# EasyEDA Pro project ProProject_Avaota Pi A_2024-03-25.epro, board 点位 (continued)
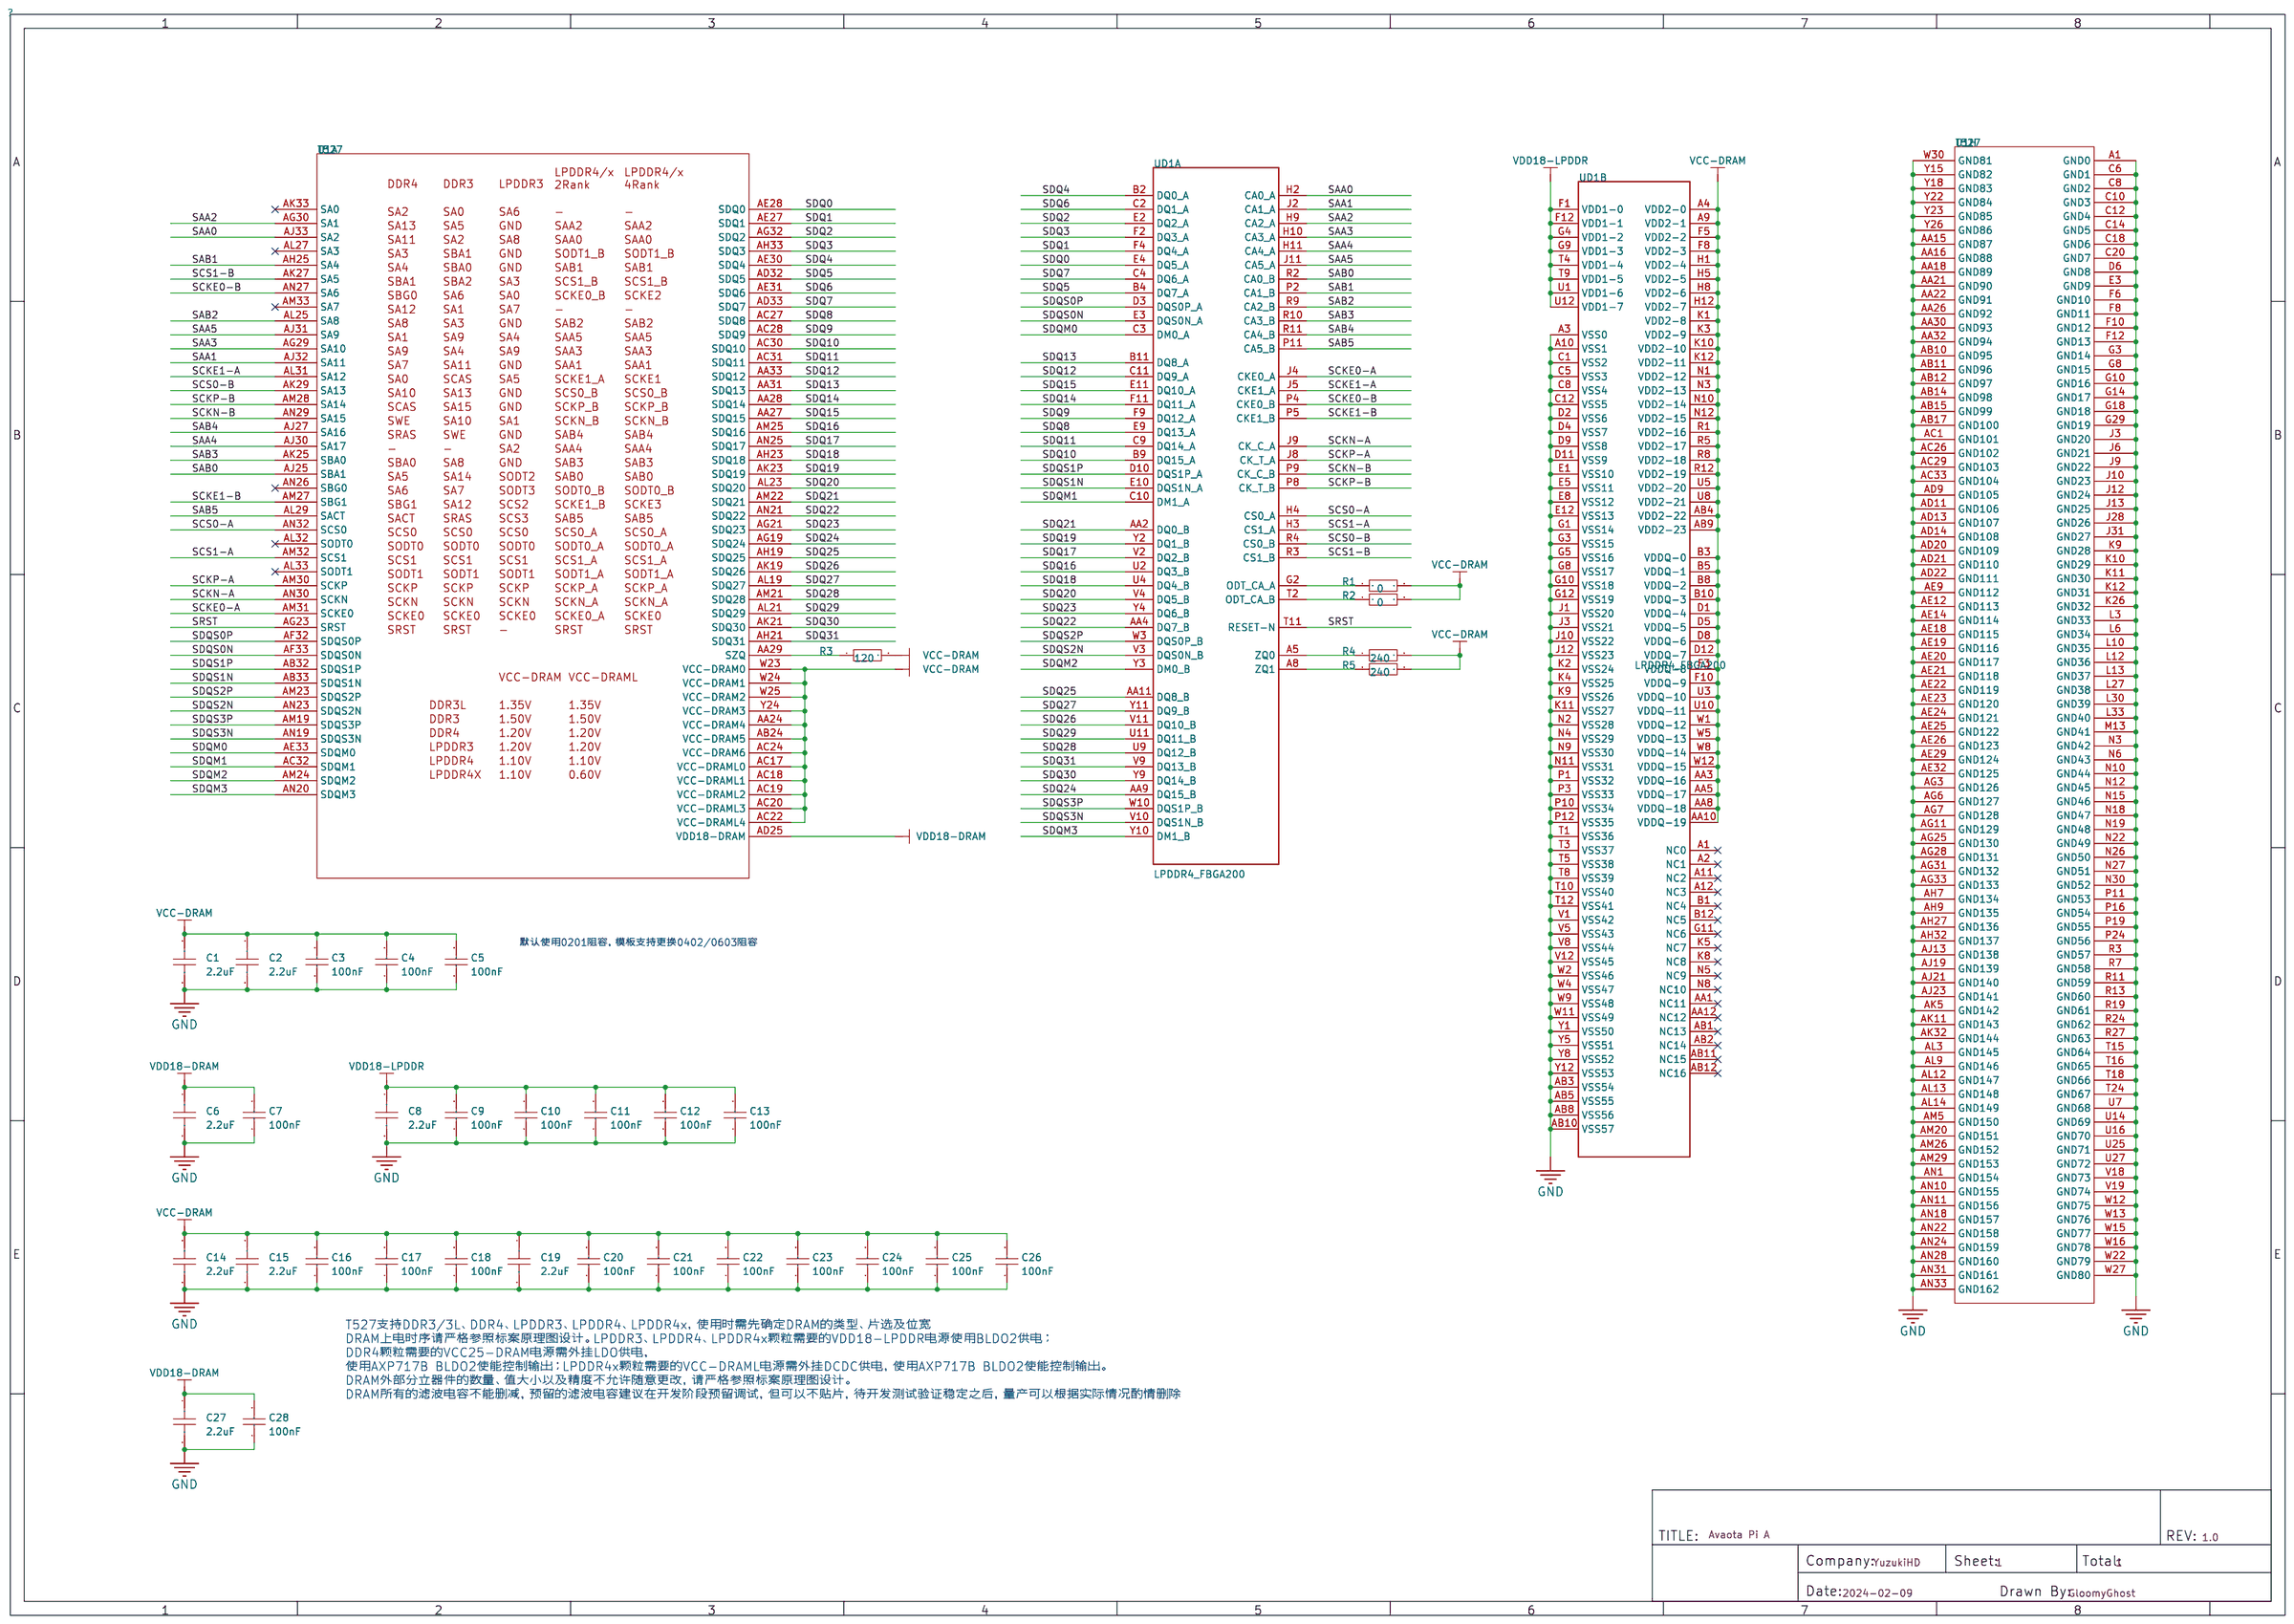
[diagram p0: schematic sheet]
## Routing (per net, layer and track width the routed paths; a pad name or vN(x,y) marks a point on that pad's centre or on a via; arc(x,y) is an arc through that point) (continued)
VCM-ADC: length 0.6
  Bottom Layer w0.203: C112.2 59.72,52.63 59.72,52.45 59.94,52.22 v1(59.94,52.15)
VRA1: length 1
  Top Layer w0.152: v3(56.92,54.15) U14.AG5
  Bottom Layer w0.152: C109.2 57.36,54.15 v3(56.92,54.15)
VRA2: length 1
  Top Layer w0.152: U14.AG4 v3(56.92,54.65)
  Bottom Layer w0.152: v3(56.92,54.65) 57.42,54.65 C110.2
VREFP-ADC: length 1.3
  Bottom Layer w0.102: v3(59.44,52.15) 59.37,52.08 R24.1
  Bottom Layer w0.203: C113.2 59.44,52.19 v3(59.44,52.15)
VRP: length 1
  Bottom Layer w0.178: C111.2 58.52,53.22 v3(58.44,53.15)
WL-REG-ON: length 55.3
  Top Layer w0.076: 61.44,55.64 61.44,55.75 61.68,56 61.68,56.27 61.52,56.44 61.51,56.6 61.43,56.95 61.39,57.32 61.41,57.7 61.5,57.91
  Top Layer w0.102: 17.06,54.76 17.3,54.53 17.3,53.95 v3(17.48,53.77) ; 61.5,57.88 61.75,58.29 62.05,58.6 62.05,60.12 61.39,60.78 56.36,60.78 54.61,59.03 34.75,59.03 27.69,51.97 20.78,51.97 18.97,53.77 v3(18.44,53.77)
  Bottom Layer w0.102: v3(18.44,53.77) v3(17.48,53.77)
WL-WAKE-AP: length 53.7
  Top Layer w0.076: 61.44,56.14 61.44,56.14 61.37,56.22 61.35,56.47 61.18,56.84 61.14,57.35 61.19,57.81 61.46,58.36
  Top Layer w0.102: 61.47,58.34 61.77,58.65 61.77,59.92 61.21,60.48 56.49,60.48 54.74,58.73 34.98,58.73 27.91,51.66 20.55,51.66 18.85,53.37 18.26,53.37 17.96,53.66 17.96,54.76
X32KIN: length 7.9
  Top Layer w0.102: 50.91,52.89 50.66,52.89 50.4,52.63 X2.1 ; 50.91,52.89 R25.1 51.06,53.77 51.36,53.77 51.61,53.51 51.61,51.3 52.27,50.65 U14.AM12 ; 50.91,52.89 50.94,52.87
X32KOUT: length 8
  Top Layer w0.102: X2.2 50.35,55.18 50.62,54.91 C101.2 R25.2 51.02,53.99 51.41,53.99 51.84,53.56 51.84,51.4 52.38,50.87 53.67,50.87 U14.AM11
$1N3725: length 1
  Top Layer w0.254: C43.1 8.86,48.11 U4.7
$1N4703: length 2.3
  Top Layer w0.152: R13.2 4.23,55.72 4.8,55.14 5.02,55.14 5.73,54.43 U4.39
$1N4806: length 2.5
  Top Layer w0.203: U4.38 6.46,55.05 6.35,55.17 5.55,55.17 5.24,55.47 4.95,55.47 4.78,55.65 R14.2
$1N7320: length 0.8
  Top Layer w0.203: U5.8 14.2,43.01 C88.1
$1N42597: length 1.5
  Top Layer w0.152: R17.1 16.55,50.82 LED1.1
$2N1846: length 1.2
  Bottom Layer w0.127: SW1.4 2.49,44.32 R21.1
$2N1994: length 1.4
  Bottom Layer w0.152: R22.1 2.58,53.42 SW2.4
$2N2360: length 4.1
  Top Layer w0.076: 60.94,55.14 60.69,55.39 60.69,55.8 60.69,55.81 60.85,55.97 60.85,56.28 60.64,56.57 60.54,56.59 60.41,56.9 60.38,57.42
  Top Layer w0.102: 60.38,57.4 60.36,57.42 R19.1
$2N2431: length 3.5
  Top Layer w0.076: 60.92,55.67 61.03,55.94 61.03,55.99 61.02,56.01 61.02,56.34 60.81,56.63 60.67,57.03 60.6,57.53
  Top Layer w0.102: 60.6,57.53 60.6,58.47 60.92,58.78 R20.1
$2N7803: length 1.4
  Top Layer w0.152: R23.1 1.97,65.05 SW3.4
$3N7591: length 1.3
  Top Layer w0.115: 59.43,42.14 59.46,42.12 v2(59.9,42.12)
  Bottom Layer w0.152: v2(59.9,42.12) 59.58,42.12 59.41,42.29 59.41,42.53 59.38,42.56
$3N7643: length 1.4
  Top Layer w0.115: 39.01,40.3 39.01,40.28 v2(38.71,39.98)
  Bottom Layer w0.115: 39.27,39.45 38.98,39.45 38.71,39.73 v2(38.71,39.98)
$3N7644: length 1.3
  Top Layer w0.115: v2(36.52,39.78) 36.61,39.86 36.61,40.3
  Bottom Layer w0.115: 36.43,40.45 36.43,39.87 v2(36.52,39.78)
$3N7648: length 3.5
  Top Layer w0.115: 41.41,44.2 41.71,44.5 42.8,44.5 43.23,44.07 43.23,43.12 43.34,43.01 43.61,43.01
$3N7649: length 3
  Top Layer w0.115: 41.41,50.05 41.7,49.76 43.43,49.76 43.66,49.99 44.15,49.99 44.19,50.03
$4N500: length 3.3
  Top Layer w0.076: 59.99,40.63 59.99,39.77 60.17,39.6 60.17,38.74 60.11,38.45
  Top Layer w0.102: R41.2 59.53,37.72 60.11,38.29 60.11,38.47
$4N609: length 4.5
  Top Layer w0.076: 68.44,47.14 68.69,46.89 70.44,46.89 70.76,47.22 71.62,47.22 71.75,47.09 72.48,47.09 R42.1
$4N713: length 3
  Top Layer w0.076: 62.44,56.14 62.46,56.17 62.54,56.87 62.52,56.91 62.46,57.5 62.46,57.52 ; 62.46,57.48 62.46,57.48
  Top Layer w0.102: 62.46,57.48 62.46,57.91 62.99,58.45 R43.1
$5N3909: length 3.5
  Top Layer w0.076: R123.2 65.33,57.34 65.03,57.04 65.03,55.74 64.94,55.64
$6N1044: length 1
  Top Layer w0.102: U14.G22 v3(66.44,46.15)
  Bottom Layer w0.152: v3(66.44,46.15) 66.44,45.69 R44.2
$6N1104: length 1
  Top Layer w0.102: v3(66.44,45.15) U14.G24
  Bottom Layer w0.152: v3(66.44,45.15) 66.43,45.14 R46.2
$6N1424: length 1.1
  Top Layer w0.102: U14.F28 v3(66.94,43.15)
  Bottom Layer w0.254: v3(66.94,43.15) 66.62,43.47 R55.2
$6N1887: length 3.3
  Top Layer w0.102: U14.G20 v3(66.44,47.18)
  Bottom Layer w0.102: v3(66.44,47.18) 66.89,47.18 67.26,47.55 68.12,47.55 68.33,47.35 R45.1
$6N1980: length 2.5
  Top Layer w0.102: U14.E20 v3(67.44,47.18)
  Bottom Layer w0.102: v3(67.44,47.18) 67.44,47.04 67.72,46.76 67.97,46.76 68.17,46.56 68.8,46.56 R49.2
$6N3848: length 0.9
  Top Layer w0.127: R47.2 D7.2
$6N3980: length 12.6
  Top Layer w0.102: v3(41.61,18.82) 41.61,19.02 40.71,19.92 D8.1
  Top Layer w0.127: R48.2 40.71,21.84 D8.10 D8.1
  Bottom Layer w0.102: v3(41.61,18.82) 41.88,19.1 42.52,19.1 44.83,16.79 44.83,14.96 44.27,14.4 44.27,13.67 43.54,12.94
$6N4130: length 7
  Top Layer w0.508: D9.1 39.57,17.55 39.5,17.48 39.5,16.84 40.18,16.15 40.41,16.15 40.74,15.83 USB1.18
$6N4341: length 10.6
  Top Layer w0.102: v3(42.09,18.69) 42.09,19 41.21,19.88 D8.2
  Top Layer w0.127: D8.2 D8.9 41.21,21.93 ; R52.2 41.21,21.94 41.21,21.93 ; 41.21,21.93 R50.2
  Bottom Layer w0.102: v3(42.09,18.69) 42.44,18.69 44.53,16.61 44.53,15.08 USB1.15
$6N4352: length 8.5
  Top Layer w0.102: D8.4 42.21,19.95 42.47,19.69 42.47,17.07 42.63,16.91 arc(42.69,16.79) 42.72,16.66 arc(42.77,16.48) 42.88,16.33 arc(43.02,16.16) 43.13,15.98 arc(43.16,15.82) 43.13,15.67 arc(43.06,15.55) 42.98,15.44 arc(42.72,15.08) USB1.16
  Top Layer w0.127: R53.2 42.4,22.21 42.21,22.02 ; 42.21,22.02 D8.7 D8.4 ; 42.21,22.02 R51.2
$6N4414: length 6.3
  Top Layer w0.102: USB1.19 42.71,17.24 D8.5
  Top Layer w0.127: R54.2 42.71,21.84 D8.6 D8.5
$6N5317: length 19.1
  Top Layer w0.127: D10.1 56.84,23.9 C190.2 ; 56.86,22.6 56.72,22.46 56.72,22.4 57.63,21.49 57.63,11.74 54.66,8.77 54.66,8.41 53.93,7.68 U15.1 ; 56.88,22.6 56.88,23.88
$6N5400: length 18.1
  Top Layer w0.127: C191.2 56.36,24.76 D10.2 D10.9 56.36,22.6 56.49,22.46 56.49,22.3 57.4,21.39 57.4,11.84 54.55,8.98 U15.3
$6N5519: length 19.3
  Top Layer w0.127: C192.2 55.36,24.75 D10.4 D10.7 55.36,22.6 55.22,22.46 55.22,22.4 56.69,20.93 56.69,11.87 54.43,9.6 53.66,9.6 52.39,8.33
$6N5561: length 20.1
  Top Layer w0.127: C193.2 54.86,24.76 D10.5 D10.6 54.86,22.6 54.99,22.46 54.99,22.3 56.46,20.83 56.46,11.96 55.07,10.57 54.51,10.57 54.18,10.9 53.54,10.9 53.16,10.52 53.16,9.5 52.73,9.07 52.5,9.07 52.39,9.18 52.39,9.63
$6N5603: length 14.8
  Top Layer w0.127: C194.2 54,24.76 D11.1 D11.10 54,22.61 53.87,22.47 53.87,22.41 54.79,21.49 54.79,18.39 55.42,17.75 55.42,12.76 54.88,12.22 54.48,12.22 53.89,11.62 U15.7
$6N5645: length 14.3
  Top Layer w0.127: U15.9 54.05,12.88 54.48,12.45 54.79,12.45 55.19,12.85 55.19,17.66 54.56,18.29 54.56,21.39 53.64,22.31 53.64,22.47 53.5,22.61 D11.9 D11.2 53.5,24.76 C195.2
$6N5687: length 20.3
  Top Layer w0.127: C196.2 52.5,24.75 D11.4 D11.7 52.5,22.61 52.37,22.47 52.37,21.67 52.04,21.34 50.89,21.34 49.43,19.87 49.43,12.75 50.34,11.84 50.5,11.84 50.62,11.96 50.62,12.55 50.75,12.67 50.88,12.67 51,12.55 51,11.96 51.13,11.84 51.26,11.84 51.38,11.96 51.38,12.55 51.51,12.67 51.64,12.67 51.77,12.55 51.77,11.96 51.89,11.84 52.17,11.84 52.39,12.05 52.39,12.23
$6N5729: length 20.4
  Top Layer w0.127: C197.2 52,24.76 D11.5 D11.6 52,22.61 52.14,22.47 52.14,21.76 51.94,21.56 50.8,21.56 49.2,19.96 49.2,12.62 50.24,11.58 52.73,11.58 53.06,11.91 53.06,12.57 52.39,13.25 52.39,13.53
$6N6451: length 14.7
  Top Layer w0.127: R61.2 49.69,24.8 C199.2 49.64,24.75 D12.2 49.64,22.6 49.5,22.47 49.5,21.6 49.68,21.42 v3(49.68,21.41)
  Bottom Layer w0.127: v3(49.68,21.41) 49.68,21.15 49.53,21 49.53,16.69 50.29,15.93 51.51,15.93 51.66,16.08 51.66,16.51 51.94,16.79 52.76,16.79 53.89,17.92 U15.17
$6N6466: length 14.6
  Top Layer w0.127: v3(49.15,21.41) 49.15,21.48 49.28,21.6 49.28,22.47 49.14,22.6 D12.1 49.14,24.75 C198.2 49.09,24.8 R62.2
  Bottom Layer w0.127: 53.89,16.78 53.89,16.65 52.7,15.47 51.79,15.47 51.56,15.7 50.2,15.7 49.28,16.62 49.28,21.02 49.15,21.15 v3(49.15,21.41)
$6N6553: length 1.2
  Bottom Layer w0.102: R57.2 52.38,14.82 52.39,14.83
$6N6556: length 3.4
  Bottom Layer w0.102: U15.13 53.89,15.3 52.78,14.2 51.26,14.2 R56.2
$6N19248: length 8.5
  Top Layer w0.127: C220.2 29.15,17.17 D15.6 29.15,15.08 29.28,14.95 29.28,14.53 28.73,13.97 27.03,13.97 25.91,12.85 25.91,12.19 25.65,11.94 USB2.18
$6N19249: length 8.5
  Top Layer w0.127: USB2.17 26.39,11.94 26.14,12.19 26.14,12.76 27.12,13.74 28.82,13.74 29.51,14.43 29.51,14.95 29.65,15.08 D15.7 D15.4 29.65,17.2
$6N30377: length 1.2
  Top Layer w0.152: R117.1 91.57,64.56 U17.3
$8N2040: length 3.5
  Bottom Layer w0.102: 92.81,52.88 92.81,52.05 D16.1 91.4,50.83 90.68,50.83
$8N6741: length 2.6
  Top Layer w0.254: LED2.1 4.45,17.02 LED3.3
$8N6795: length 2.6
  Top Layer w0.254: LED4.3 2.62,12.26 LED3.1
$8N6805: length 2.6
  Top Layer w0.254: LED4.1 4.45,11.12 LED5.3
$8N9148: length 1.8
  Bottom Layer w0.102: R115.2 R116.1 86.79,47.73 86.82,47.76
$8N11462: length 6.4
  Top Layer w0.254: v1(90.02,45.52) 88.57,45.52 87.28,44.23 87.28,42.38
  Bottom Layer w0.254: v1(90.02,45.52) 88.77,45.52 R126.1
$10N1043: length 3.1
  Bottom Layer w0.508: C248.2 60.56,16.15 RJ1.P1
$10N3488: length 7.9
  Top Layer w0.152: R79.2 57.56,5.25 57.56,4.34 59.08,2.82 61.8,2.82 RJ1.12
$10N3497: length 15.6
  Top Layer w0.152: RJ1.13 70.21,2.54 62.51,2.54 61.95,3.1 59.23,3.1 57.86,4.47 57.86,5.23 57.99,5.36 R80.1
$11N1789: length 3.3
  Bottom Layer w0.508: RJ2.P1 78.85,16.1 C255.2
$11N1876: length 8
  Top Layer w0.152: R97.2 75.96,5.2 76.12,5.03 76.12,3.48 77.06,2.54 80.32,2.54 RJ2.12
$11N1882: length 15.8
  Top Layer w0.152: 89.51,1.48 88.35,2.64 80.82,2.64 80.52,2.95 77.04,2.95 76.4,3.58 76.4,5.03 76.56,5.19 R98.1
$12N673: length 3.6
  Top Layer w0.254: 20.62,22.27 20.62,22.28 R1.1 19.36,21.9 Q1.1
$12N750: length 4.9
  Top Layer w0.254: DC1.5 7.67,6.26 C3.2
$12N1163: length 3.8
  Top Layer w0.254: U3.1 10.72,29.74 10.59,29.62 9.42,29.62 8.53,28.73 C4.1
$12N1491: length 1.6
  Top Layer w0.508: C8.2 14.9,30.39 U3.4
$12N1559: length 2.7
  Top Layer w0.254: D4.2 8.56,30.27 8.56,29.62 C4.2
$12N1618: length 3.7
  Top Layer w0.254: U3.6 13.26,36.78 12.5,37.54 12.14,37.54 11.58,38.1 C9.1 C10.1
$12N1697: length 0.9
  Top Layer w0.254: C9.2 11.56,39.95 R7.1
$12N1966: length 0.9
  Top Layer w0.254: R5.2 13.43,38.13 R3.1
$12N2016: length 4.4
  Top Layer w0.254: 12.47,39.07 R5.1 12.98,37.57 14.27,37.57 14.53,37.31 U3.5
$12N2052: length 4.3
  Top Layer w0.254: U3.3 13.28,30.73 13.28,29.57 13.52,29.33 R6.2 15.27,28.35 R4.1
$12N3300: length 6.1
  Top Layer w0.508: CN1.1 19.41,29.85 19.84,30.28 19.84,31.45 19.23,32.06 17.88,32.06 D1.1
$13N975: length 1.7
  Top Layer w0.127: RF1.1 9.91,64.17 C245.2 R72.2
$13N1231: length 1.3
  Bottom Layer w0.102: R76.1 94.27,19.05 94.56,19.05 95.02,18.59 U11.8
$13N1378: length 0.5
  Top Layer w0.254: R77.1 94.47,20.21 94.47,20.21
$13N1478: length 6.7
  Top Layer w0.254: R77.2 93.96,21.09 94.77,21.9 CN3.1 95.4,21.9 v1(96.27,21.03)
  Bottom Layer w0.254: v1(96.27,21.03) 97,20.29 97,19.58 96.29,18.87 96.29,18.32
$13N1485: length 9.5
  Top Layer w0.254: R78.2 94.88,21.11 95.35,21.11 95.88,20.57 96.52,20.57 96.8,20.85 v1(96.8,21.34) 96.77,21.34 96.27,21.84 96.27,22.45 95.56,23.16 CN3.2
  Bottom Layer w0.254: U11.6 97.56,20.57 v1(96.8,21.34)
$13N1600: length 0.5
  Bottom Layer w0.127: 70.5,68.57 70.49,68.58 70.49,69.09
$13N1603: length 0.5
  Bottom Layer w0.127: R66.1 C241.2
$13N2020: length 0.7
  Bottom Layer w0.254: R67.2 67.02,68.57 67.12,68.68
$13N2077: length 0.7
  Bottom Layer w0.254: C243.2 67.02,69.66 R68.2
$13N5258: length 1
  Top Layer w0.254: R125.1 95.5,16.66 CGQ1.4

## Copper pours and planes (outline as drawn; the poured copper is in the pictures)
GND on Top Layer: -8.84,81.31 106.93,81.31 106.93,-10.13 -8.84,-10.13
GND on Bottom Layer: -7.04,79.76 108.74,79.76 108.74,-11.68 -7.04,-11.68
GND on GND1: 60.53,45.47 59.1,45.47 58.8,45.77 58.8,48.21 57.99,49.02 51.81,49.02 45.36,55.47 32.43,55.47 31.93,54.97 31.93,39.5 34.87,36.55 59.15,36.55 60.81,38.2 60.81,45.19
GND on GND1: 60.53,45.49 59.1,45.49 58.8,45.8 58.8,48.24 57.98,49.05 51.81,49.05 45.36,55.5 32.43,55.5 31.92,54.99 31.92,39.52 34.87,36.58 59.15,36.58 60.8,38.23 60.8,45.21
GND on GND1: -8.17,81.08 107.6,81.08 107.6,-10.36 -8.17,-10.36
GND on 内层2: -7.99,80.77 107.79,80.77 107.79,-10.67 -7.99,-10.67
GND on VCC: 60.54,45.48 59.12,45.48 58.81,45.78 58.81,48.22 58,49.03 51.83,49.03 45.38,55.49 32.45,55.49 31.94,54.98 31.94,39.51 34.88,36.56 59.17,36.56 60.82,38.21 60.82,45.2
GND on VCC: -7.85,80.62 107.92,80.62 107.92,-10.82 -7.85,-10.82
GND on 内层4: -7.65,80.39 108.13,80.39 108.13,-11.05 -7.65,-11.05
GND on Inner5: -7.48,80.2 108.29,80.2 108.29,-11.24 -7.48,-11.24
GND on GND2: -7.29,80.01 108.48,80.01 108.48,-11.43 -7.29,-11.43
GND on GND2: 60.51,45.48 59.09,45.48 58.79,45.78 58.79,48.22 57.97,49.03 51.8,49.03 45.35,55.49 32.42,55.49 31.91,54.98 31.91,39.51 34.86,36.56 59.14,36.56 60.79,38.21 60.79,45.2
VBUS on Top Layer: 3.96,50.55 6.02,50.55 6.02,48.36 3.96,48.36
VBUS on Top Layer: 3.45,49.23 13.41,49.23 13.41,42.39 3.45,42.39
323-DCDC1/2 on Top Layer: 20.45,45.29 22.86,45.29 22.86,40.67 20.45,40.67
323-DCDC1/2 on 内层2: 59.33,48.43 59.33,45.81 59.95,45.19 62.33,45.19 62.69,45.54 62.69,50.4 52.53,60.55 32.16,60.55 27.2,55.6 27.2,52.68 20.5,45.97 20.5,41.22 21.77,39.95 23.22,39.95 25.32,42.06 25.32,44.7 31.27,50.65 31.27,54.28 32.92,55.93 47.62,55.93 54.58,48.97 58.79,48.97
323-DCDC3 on Top Layer: 15.9,48.71 19,48.71 19,47.07 15.9,47.07
323-DCDC3 on VCC: 60.81,50.9 60.81,49.91 60.3,49.4 57.51,49.4 57.48,49.43 52.22,49.43 45.82,55.83 31.75,55.83 22.22,46.3 18.03,46.3 16.71,47.61 16.71,49.15 18.97,51.41 21.72,51.41 30.4,60.1 47.65,60.1 55.6,52.15 59.56,52.15
BLDO2 on Bottom Layer: 43.23,38.99 44.66,40.42 44.66,53.91 43.31,55.27 33.34,55.27 32.02,53.96 32.02,40.14 33.17,38.99
DCDC1 on Top Layer: 11.15,47.96 13.39,47.96 13.39,45.82 11.15,45.82
DCDC1 on Bottom Layer: 10.85,47.95 12.75,47.95 12.75,45.75 10.85,45.75
DCDC1 on Inner5: 61.16,47.52 61.16,46.23 60.76,45.82 59.77,45.82 58.93,46.66 58.93,48.01 57.34,49.6 52.61,49.6 46.2,56.01 32.61,56.01 25.7,49.1 17.98,49.1 13.59,44.7 11.31,44.7 10.19,45.82 10.19,48.49 15.07,53.37 22.1,53.37 29.84,61.11 45.62,61.11 48.41,58.32 52.04,58.32 61.14,49.22 61.14,47.55
DCDC2 on Top Layer: 4.62,59.28 8.66,59.28 8.66,56.95 4.62,56.95
DCDC2 on 内层4: 58.52,49.57 58.52,49.61 52.04,49.61 45.54,56.11 19.99,56.11 16.81,59.28 14.5,59.28 13.87,59.92 10.44,59.92 9.22,58.7 9.22,57.53 8.79,57.1 6.02,57.1 5.36,57.76 5.36,60.45 7.67,62.76 20.43,62.76 22.82,60.38 54.08,60.38 65.23,49.23 65.81,49.23 66.12,48.92 66.12,48.01 63.73,45.62 63.09,45.62 62.81,45.9 62.28,45.9 62.03,46.15 62.03,47.21 61.77,47.47 60.62,47.47
DCDC3 on Top Layer: 10.69,59.97 13.41,59.97 13.41,55.73 10.69,55.73
DCDC3 on 内层4: 60.52,45.45 59.1,45.45 58.79,45.76 58.79,48.2 58.29,48.7 51.94,48.7 45.23,55.41 32.38,55.41 31.92,54.95 31.92,39.48 34.87,36.54 59.15,36.54 60.8,38.19 60.8,45.17
DCDC3 on 内层4: 10.38,57.89 10.38,55.3 10.84,54.84 12.85,54.84 14.94,52.76 14.94,51.87 17.6,49.2 32.23,49.2 33.98,50.95 33.98,55.4 19.58,55.4 16.56,58.42 14.25,58.42 13.44,59.23 11.72,59.23
DCDC4 on Bottom Layer: 3.28,54.13 5.92,54.13 5.92,52.76 3.28,52.76
DCDC4 on VCC: 2.69,54.23 4.79,54.23 4.79,52.22 2.69,52.22
DCIN-5V on Top Layer: 3.81,44.54 8.41,44.54 8.41,38.46 3.81,38.46
DCIN-12V on Top Layer: 9.27,31.93 12.7,31.93 12.7,21.59 9.27,21.59
DCIN-12V on Top Layer: 4.95,23.34 17.83,23.34 17.83,19.84 4.95,19.84
DCIN-12V on Top Layer: 17.09,25.35 17.93,25.35 17.93,21.86 17.09,21.86
GM0_DVDD10 on Top Layer: 61.45,27.48 63.04,27.48 63.04,25.76 61.45,25.76
GM0_REGOUT on Top Layer: 63.7,27.48 64.92,27.48 64.92,24.51 63.7,24.51
GM1_DVDD10 on Top Layer: 79.61,27.33 81.2,27.33 81.2,25.6 79.61,25.6
GM1_REGOUT on Top Layer: 81.86,27.32 83.09,27.32 83.09,24.35 81.86,24.35
PS on 内层2: 6.71,55.99 13.01,55.99 14.76,54.25 14.76,49.1 19.25,44.6 19.25,41.15 18.44,40.34 15.19,40.34 10.21,45.31 5.21,45.31 3.15,47.37 3.15,54.64 4.23,55.72 6.43,55.72
$1N3706 on Top Layer: 9.37,49.2 10.56,49.2 10.56,45.97 9.37,45.97
$1N3718 on Top Layer: 7.67,57.71 8.84,57.71 8.84,54.46 7.67,54.46
$1N3723 on Top Layer: 9.14,57.71 10.31,57.71 10.31,54.47 9.14,54.47
$1N4773 on Top Layer: 3.96,54.89 6.02,54.89 6.02,53.11 3.96,53.11
$1N4992 on Top Layer: 2.85,52.15 6.02,52.15 6.02,50.88 2.85,50.88
$1N6251 on Top Layer: 17.3,43.19 19.89,43.19 19.89,40.77 17.3,40.77
$1N6517 on Top Layer: 17.3,45.21 19.89,45.21 19.89,43.08 17.3,43.08
$1N6728 on Top Layer: 15.88,46.96 17.88,46.96 17.88,44.07 15.88,44.07
$12N612 on Top Layer: 14.53,19.1 19.51,19.1 19.51,8.76 14.53,8.76
$12N1559 on Top Layer: 6.25,35.87 9.17,35.87 9.17,29.9 6.25,29.9
$12N1559 on Top Layer: 3.81,37.41 11.23,37.41 11.23,32.49 3.81,32.49

Small or netless copper shapes (teardrops, artwork), in the pictures only: 2341 on Top Layer, 990 on Bottom Layer, 223 on 内层2, 65 on VCC, 64 on 内层4, 170 on Inner5, 10 on GND2

## Text on the board
Bottom Silkscreen Layer: BIOS | FEL | RST | v1.1 | RGB888/LVDS/MIPI DSI/JTAG / UART/IIC/I2S/SPI/PWM  MUX | TFCard/JTAG | OV13850 | Avaota A1
Top Silkscreen Layer: FAN | ON | LPDDR4 | Allwinner T527 | eMMC | RGB LED | 9~12V@2A DC | USB | HDMI | DP | GPIO | ETH1 | ETH0 | CAN | AUDIO | OTG&D | IR | Avaota A1 | 拆拆我的
